# Altium schematic sheet big sheet.SchDoc: <Enter Sheet Title> (part 1 of 2)
size 1651 x 812 mm; Organization: NewAE Technology Inc.; Address1: 1083 Queen St., Suite 196; Address2: Halifax; Address3: NS; Address4: Canada B3H 0B2; SheetNumber: 1; SheetTotal: 18; SheetApproved: NO
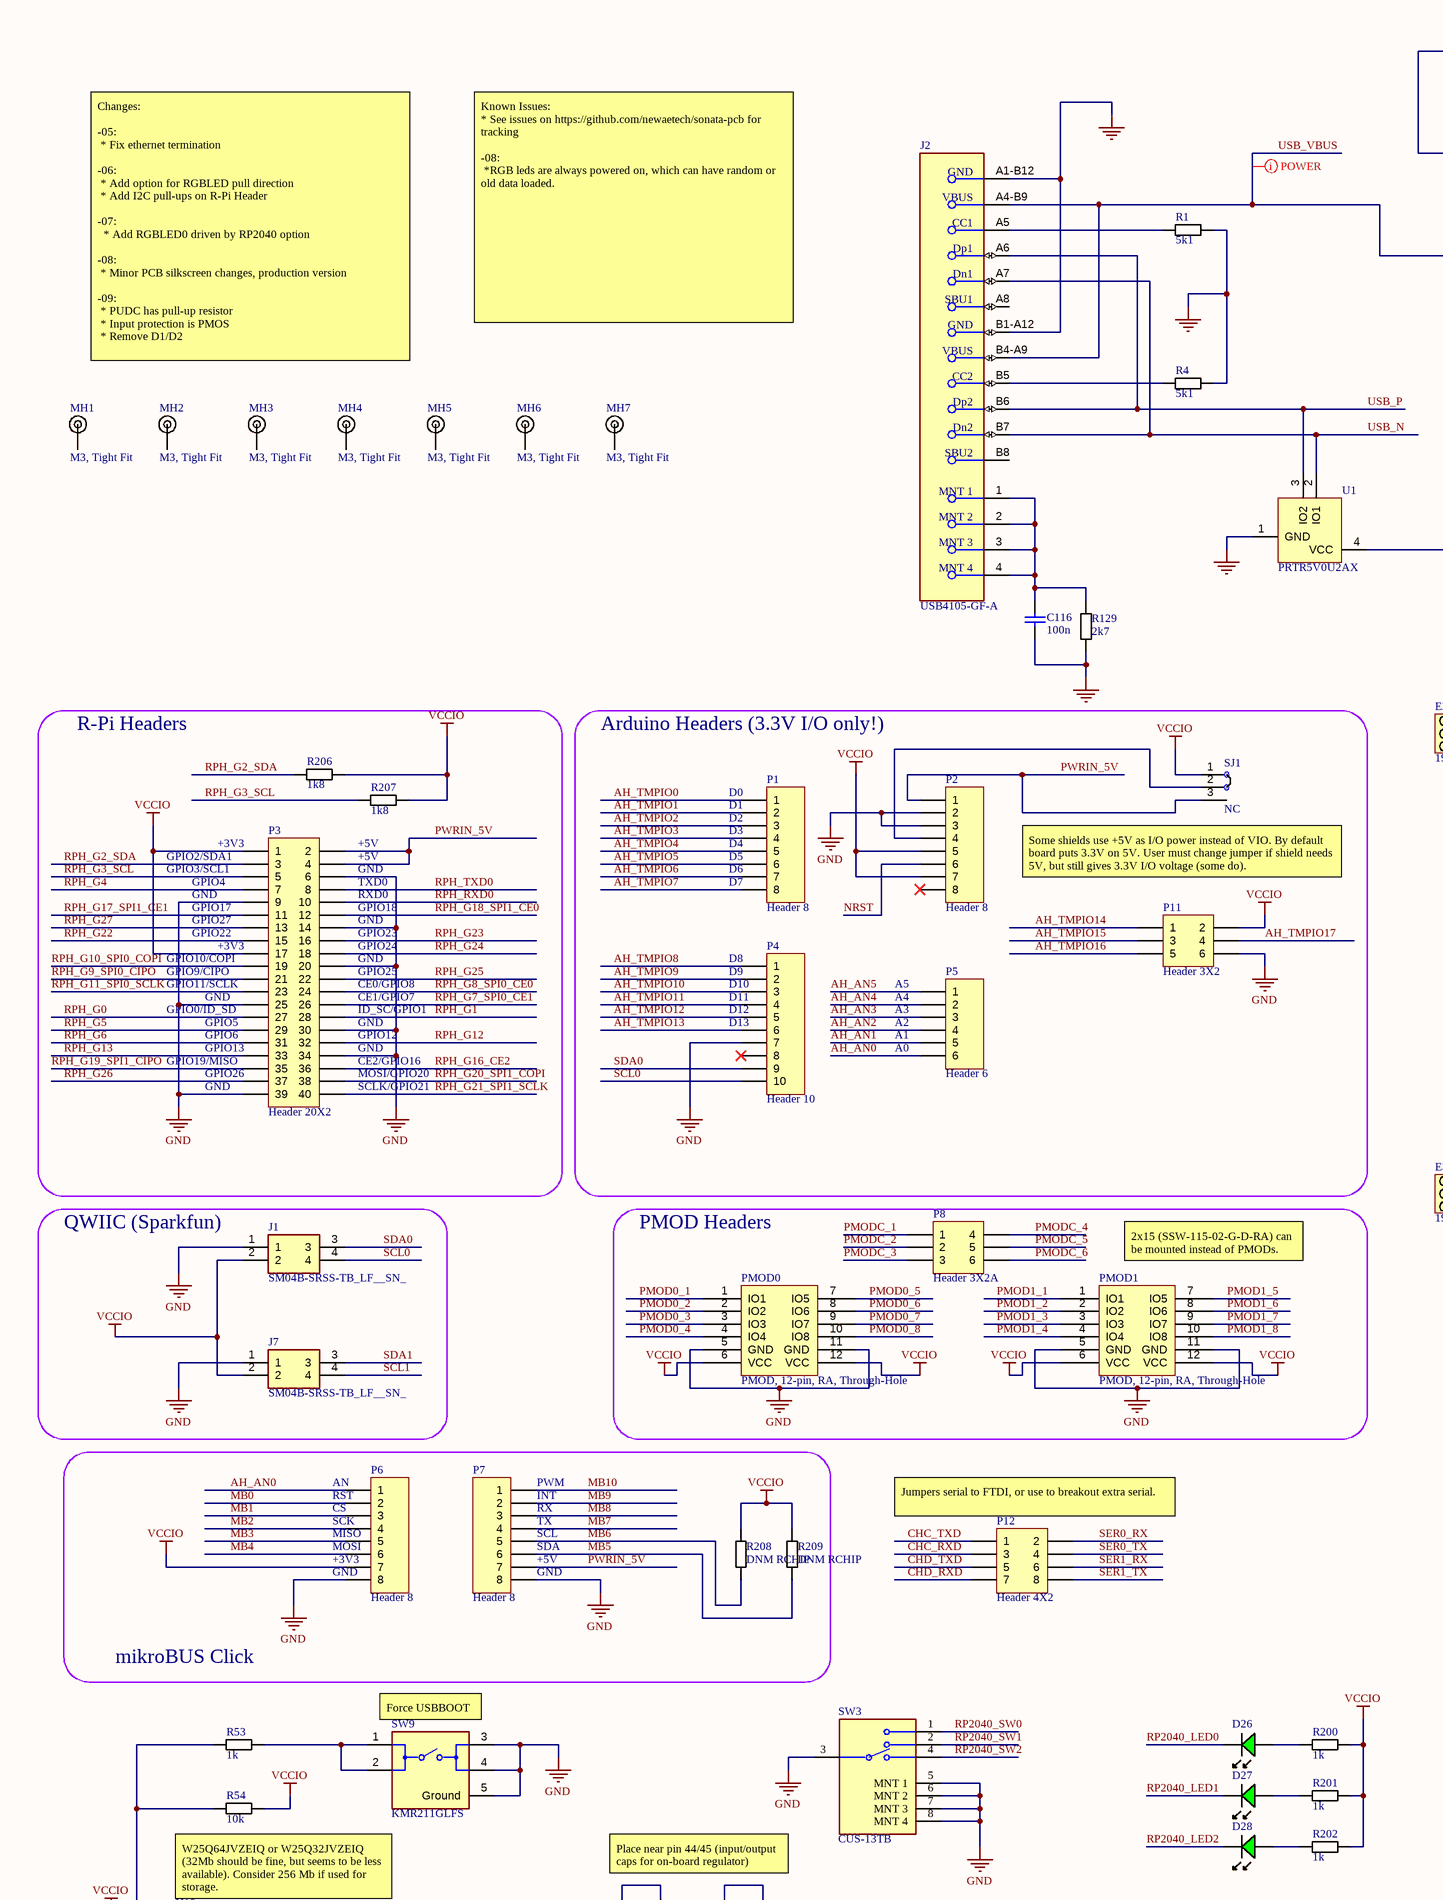
[diagram p0: big sheet.SchDoc, top column 1 of 4]
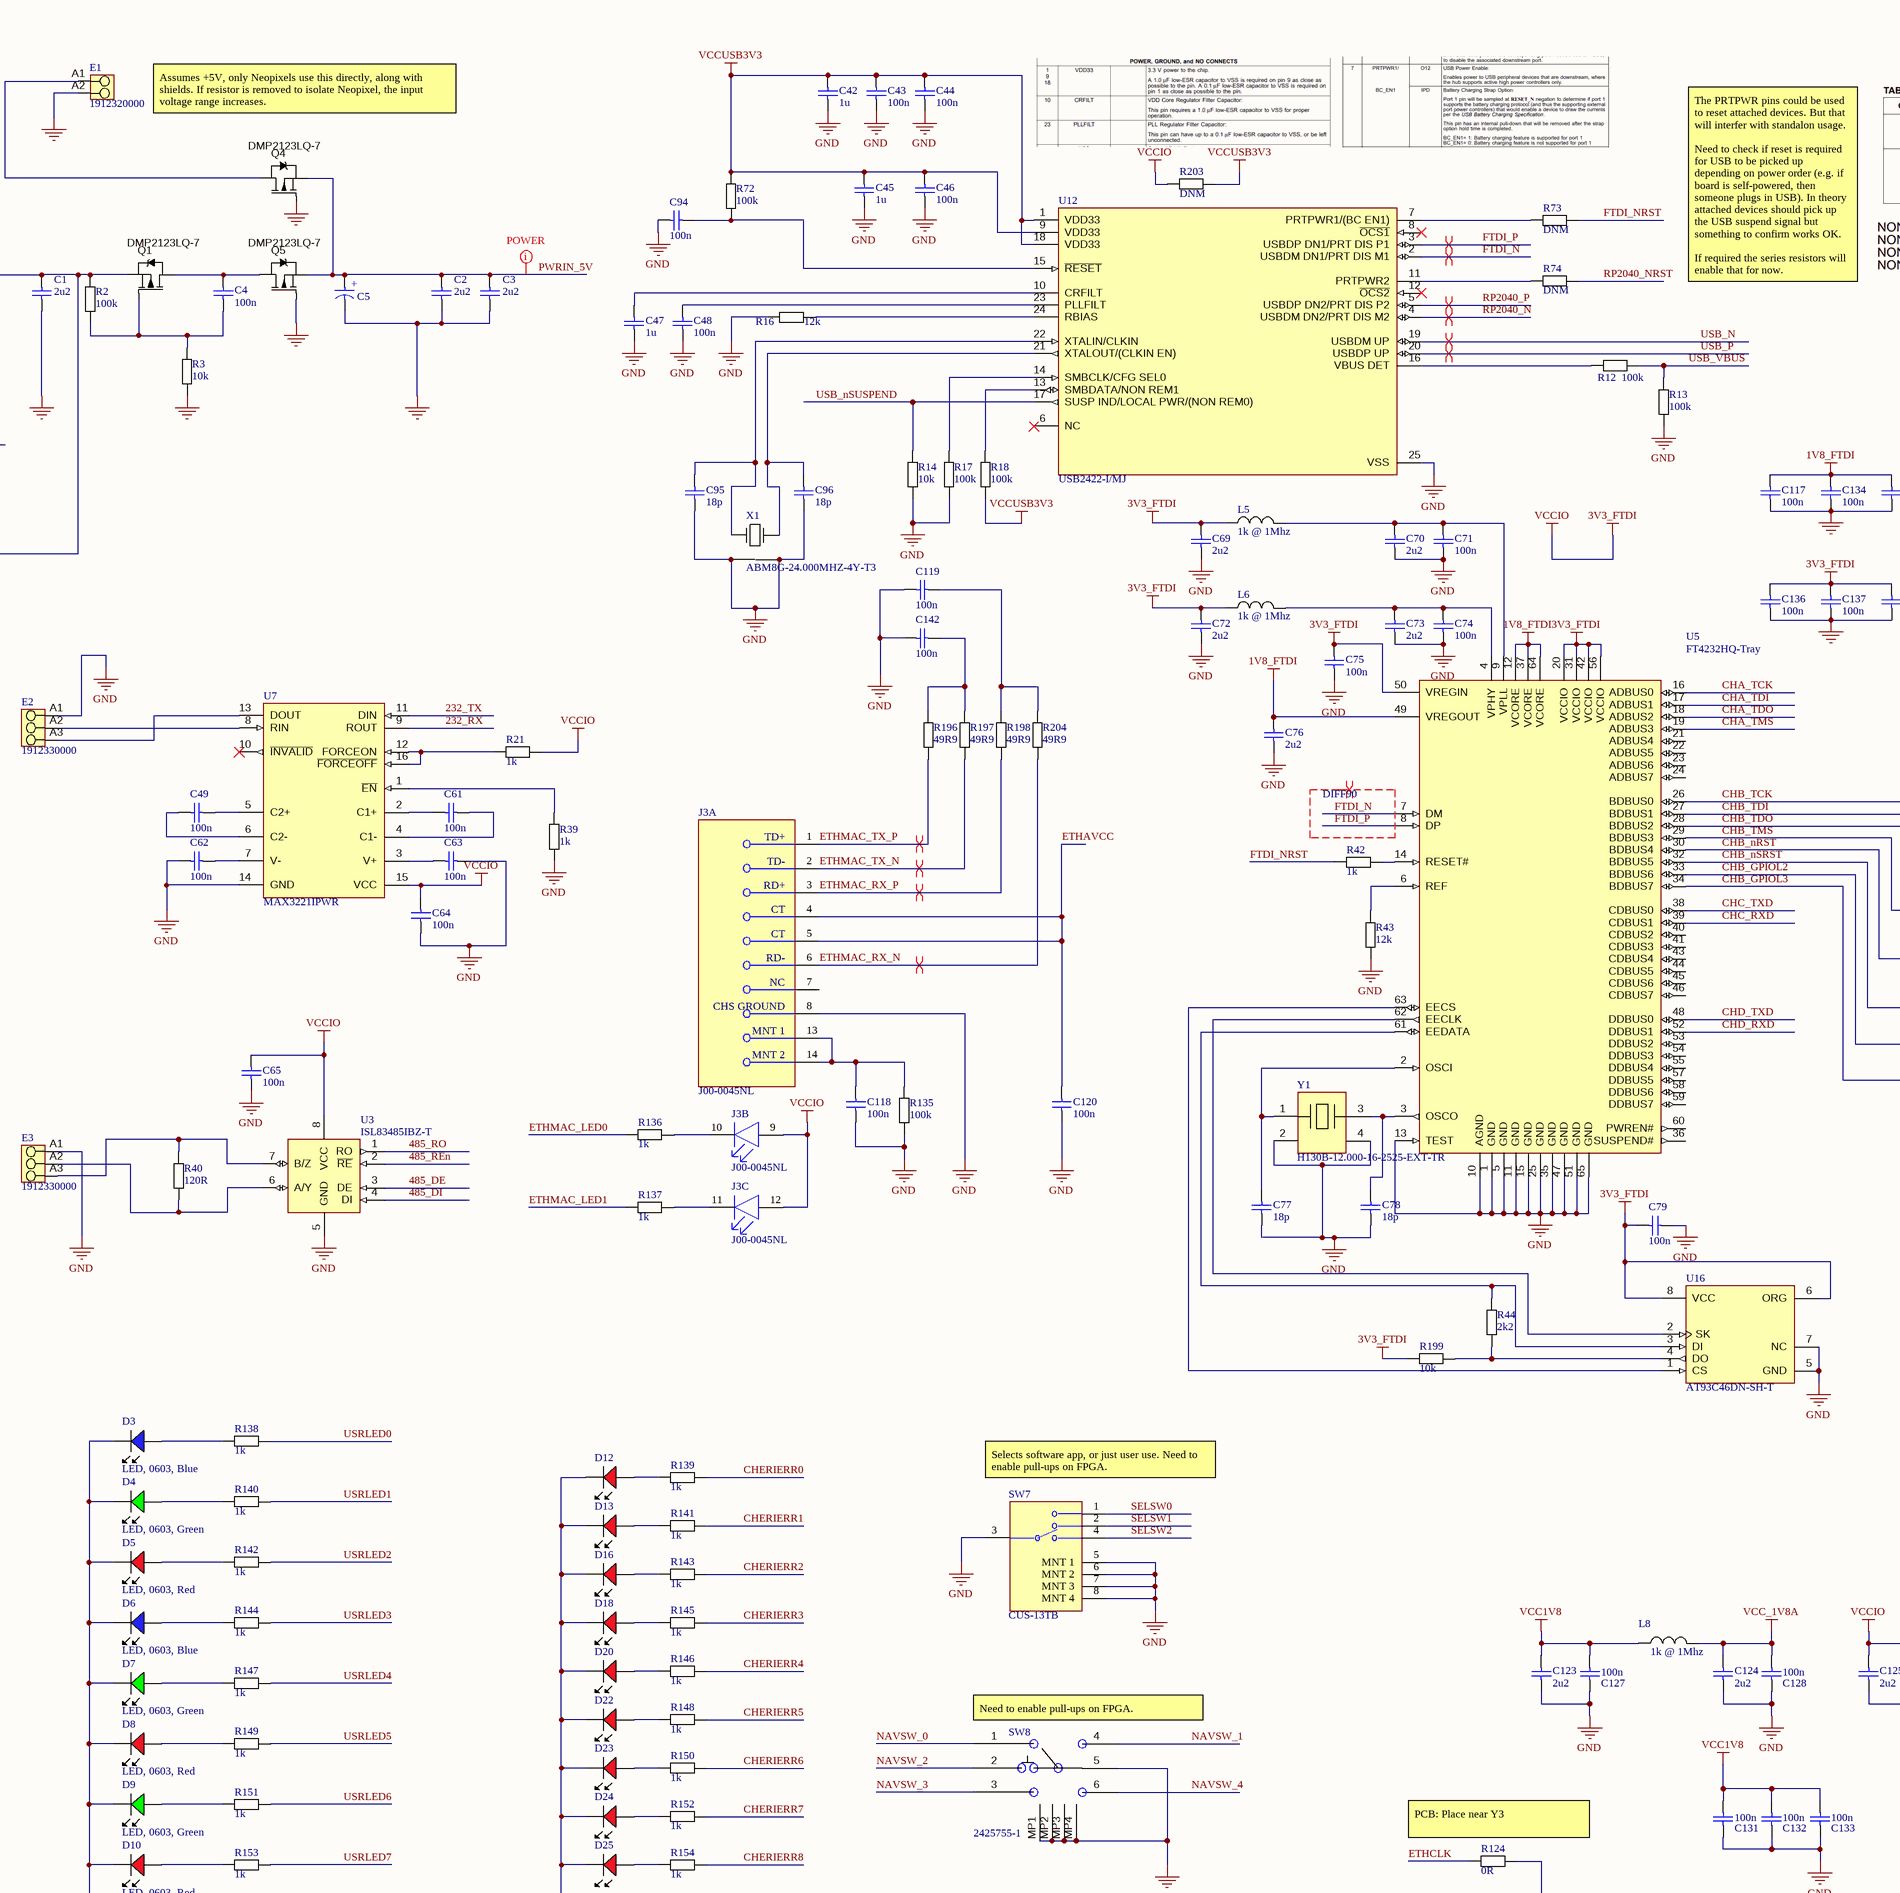
[diagram p1: big sheet.SchDoc, top column 2 of 4]
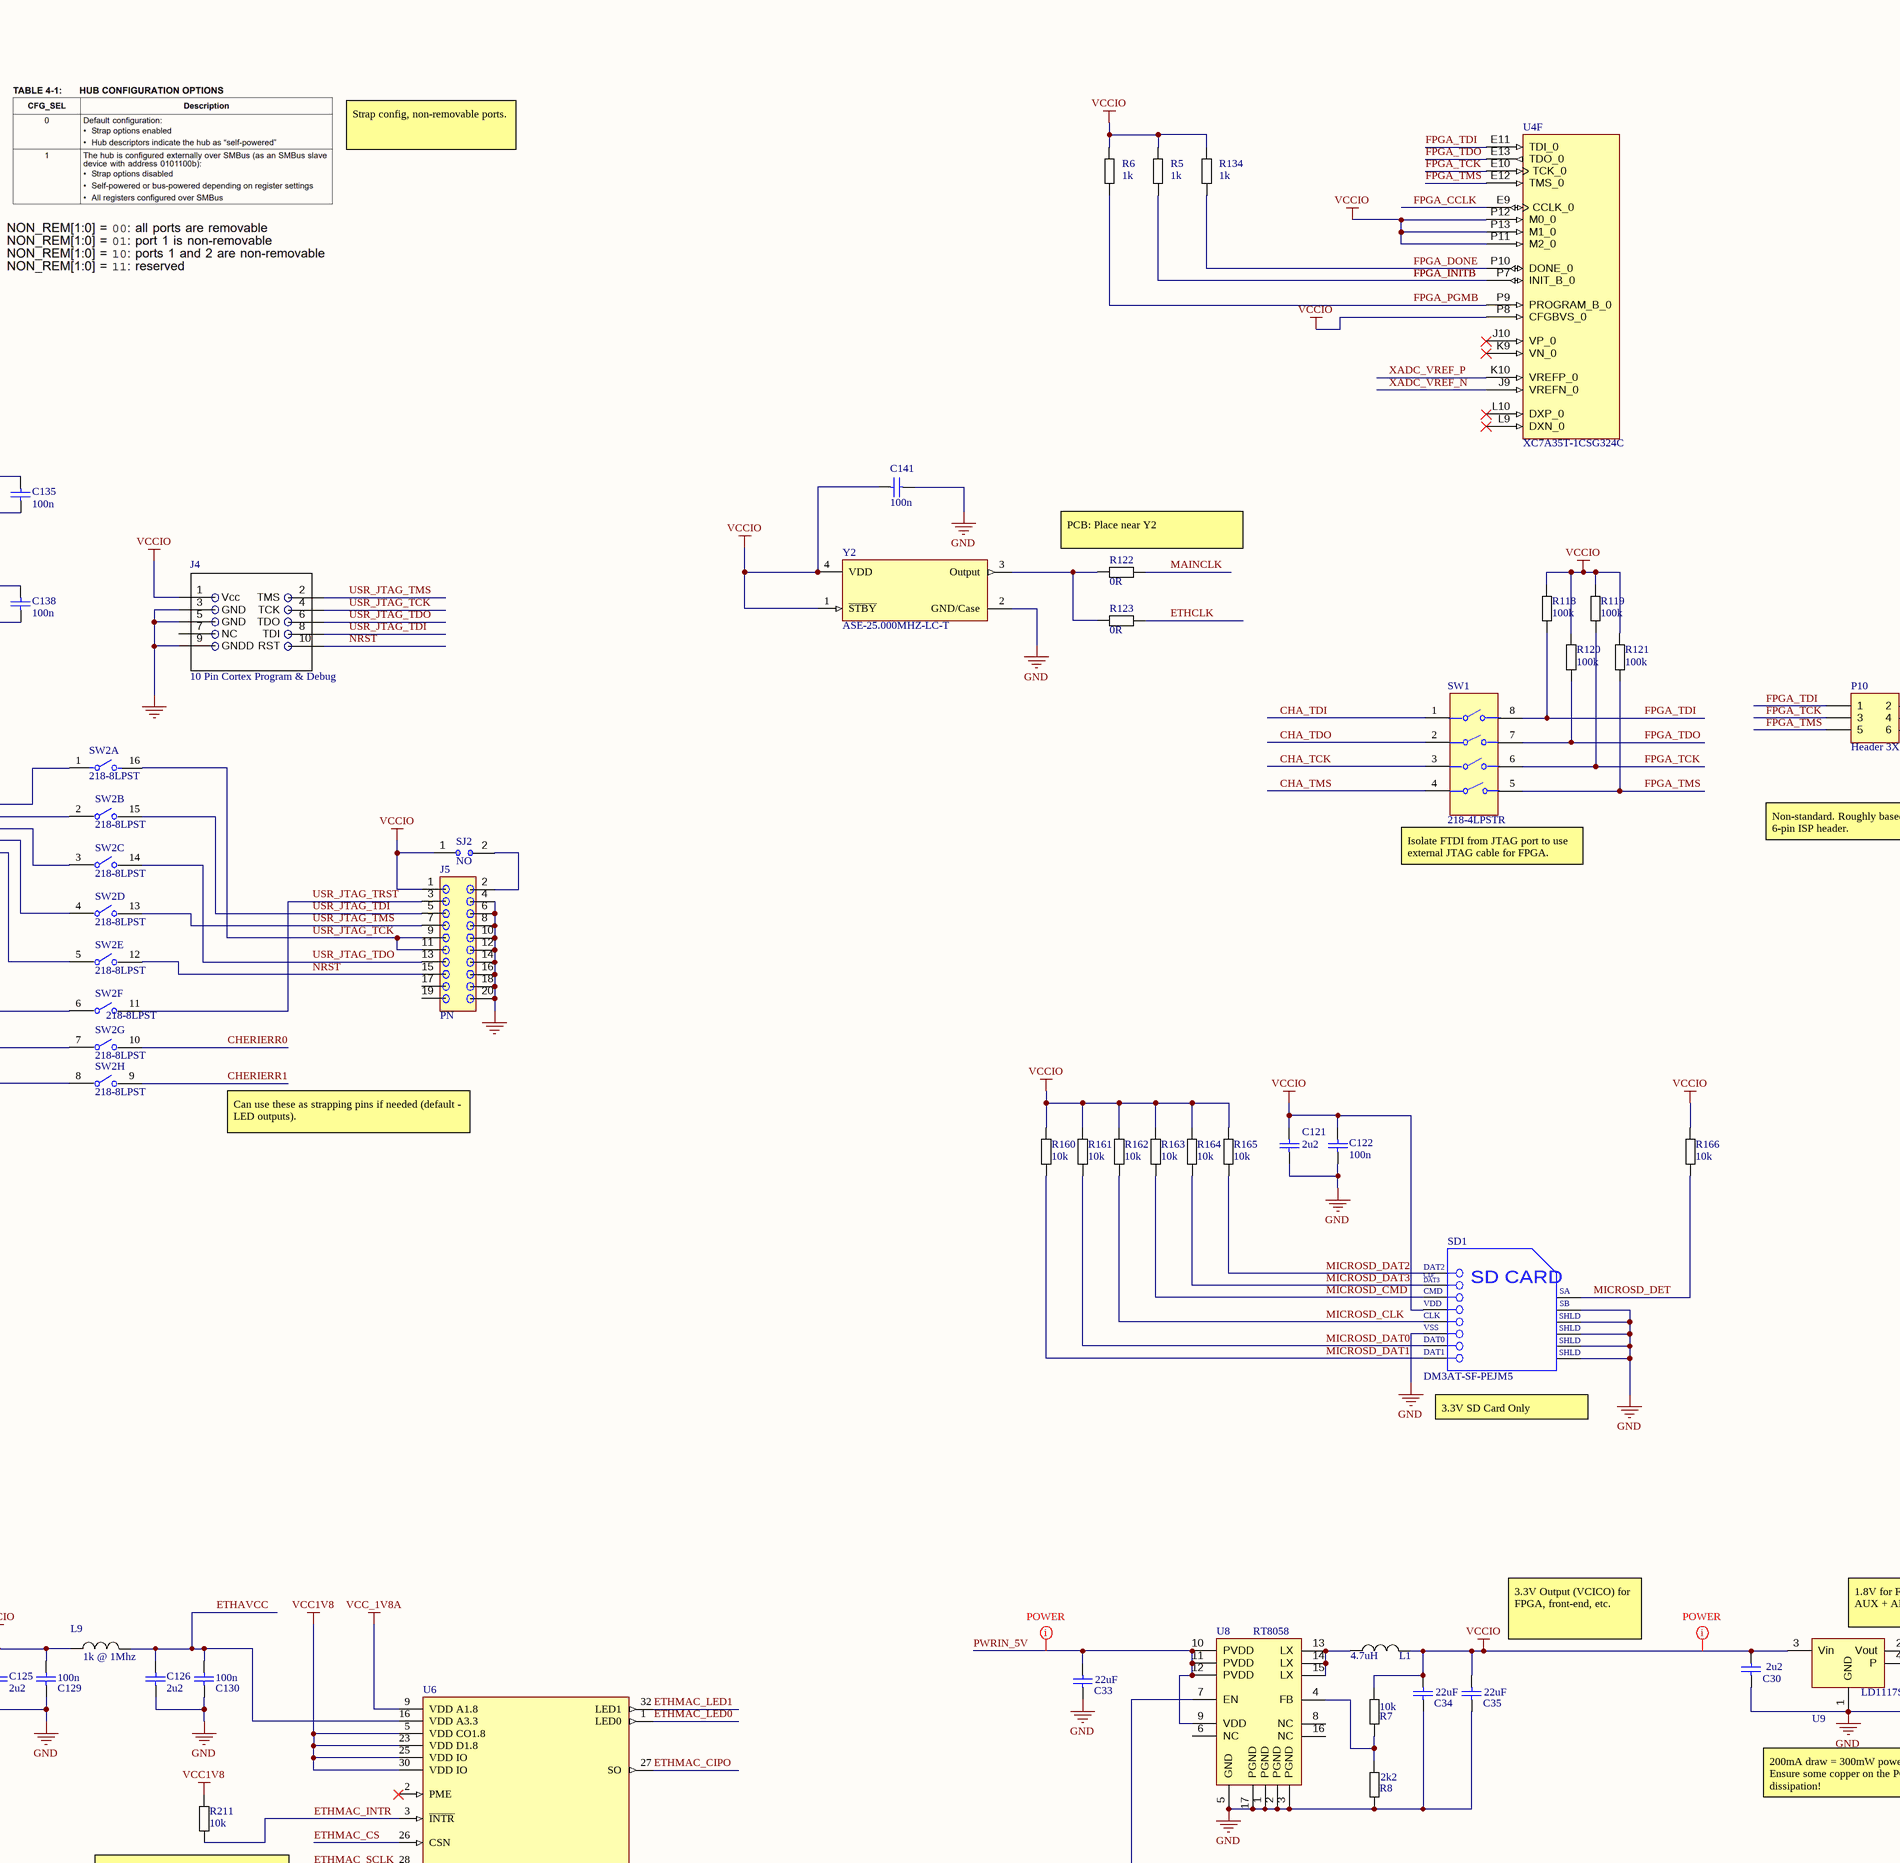
[diagram p2: big sheet.SchDoc, top column 3 of 4]
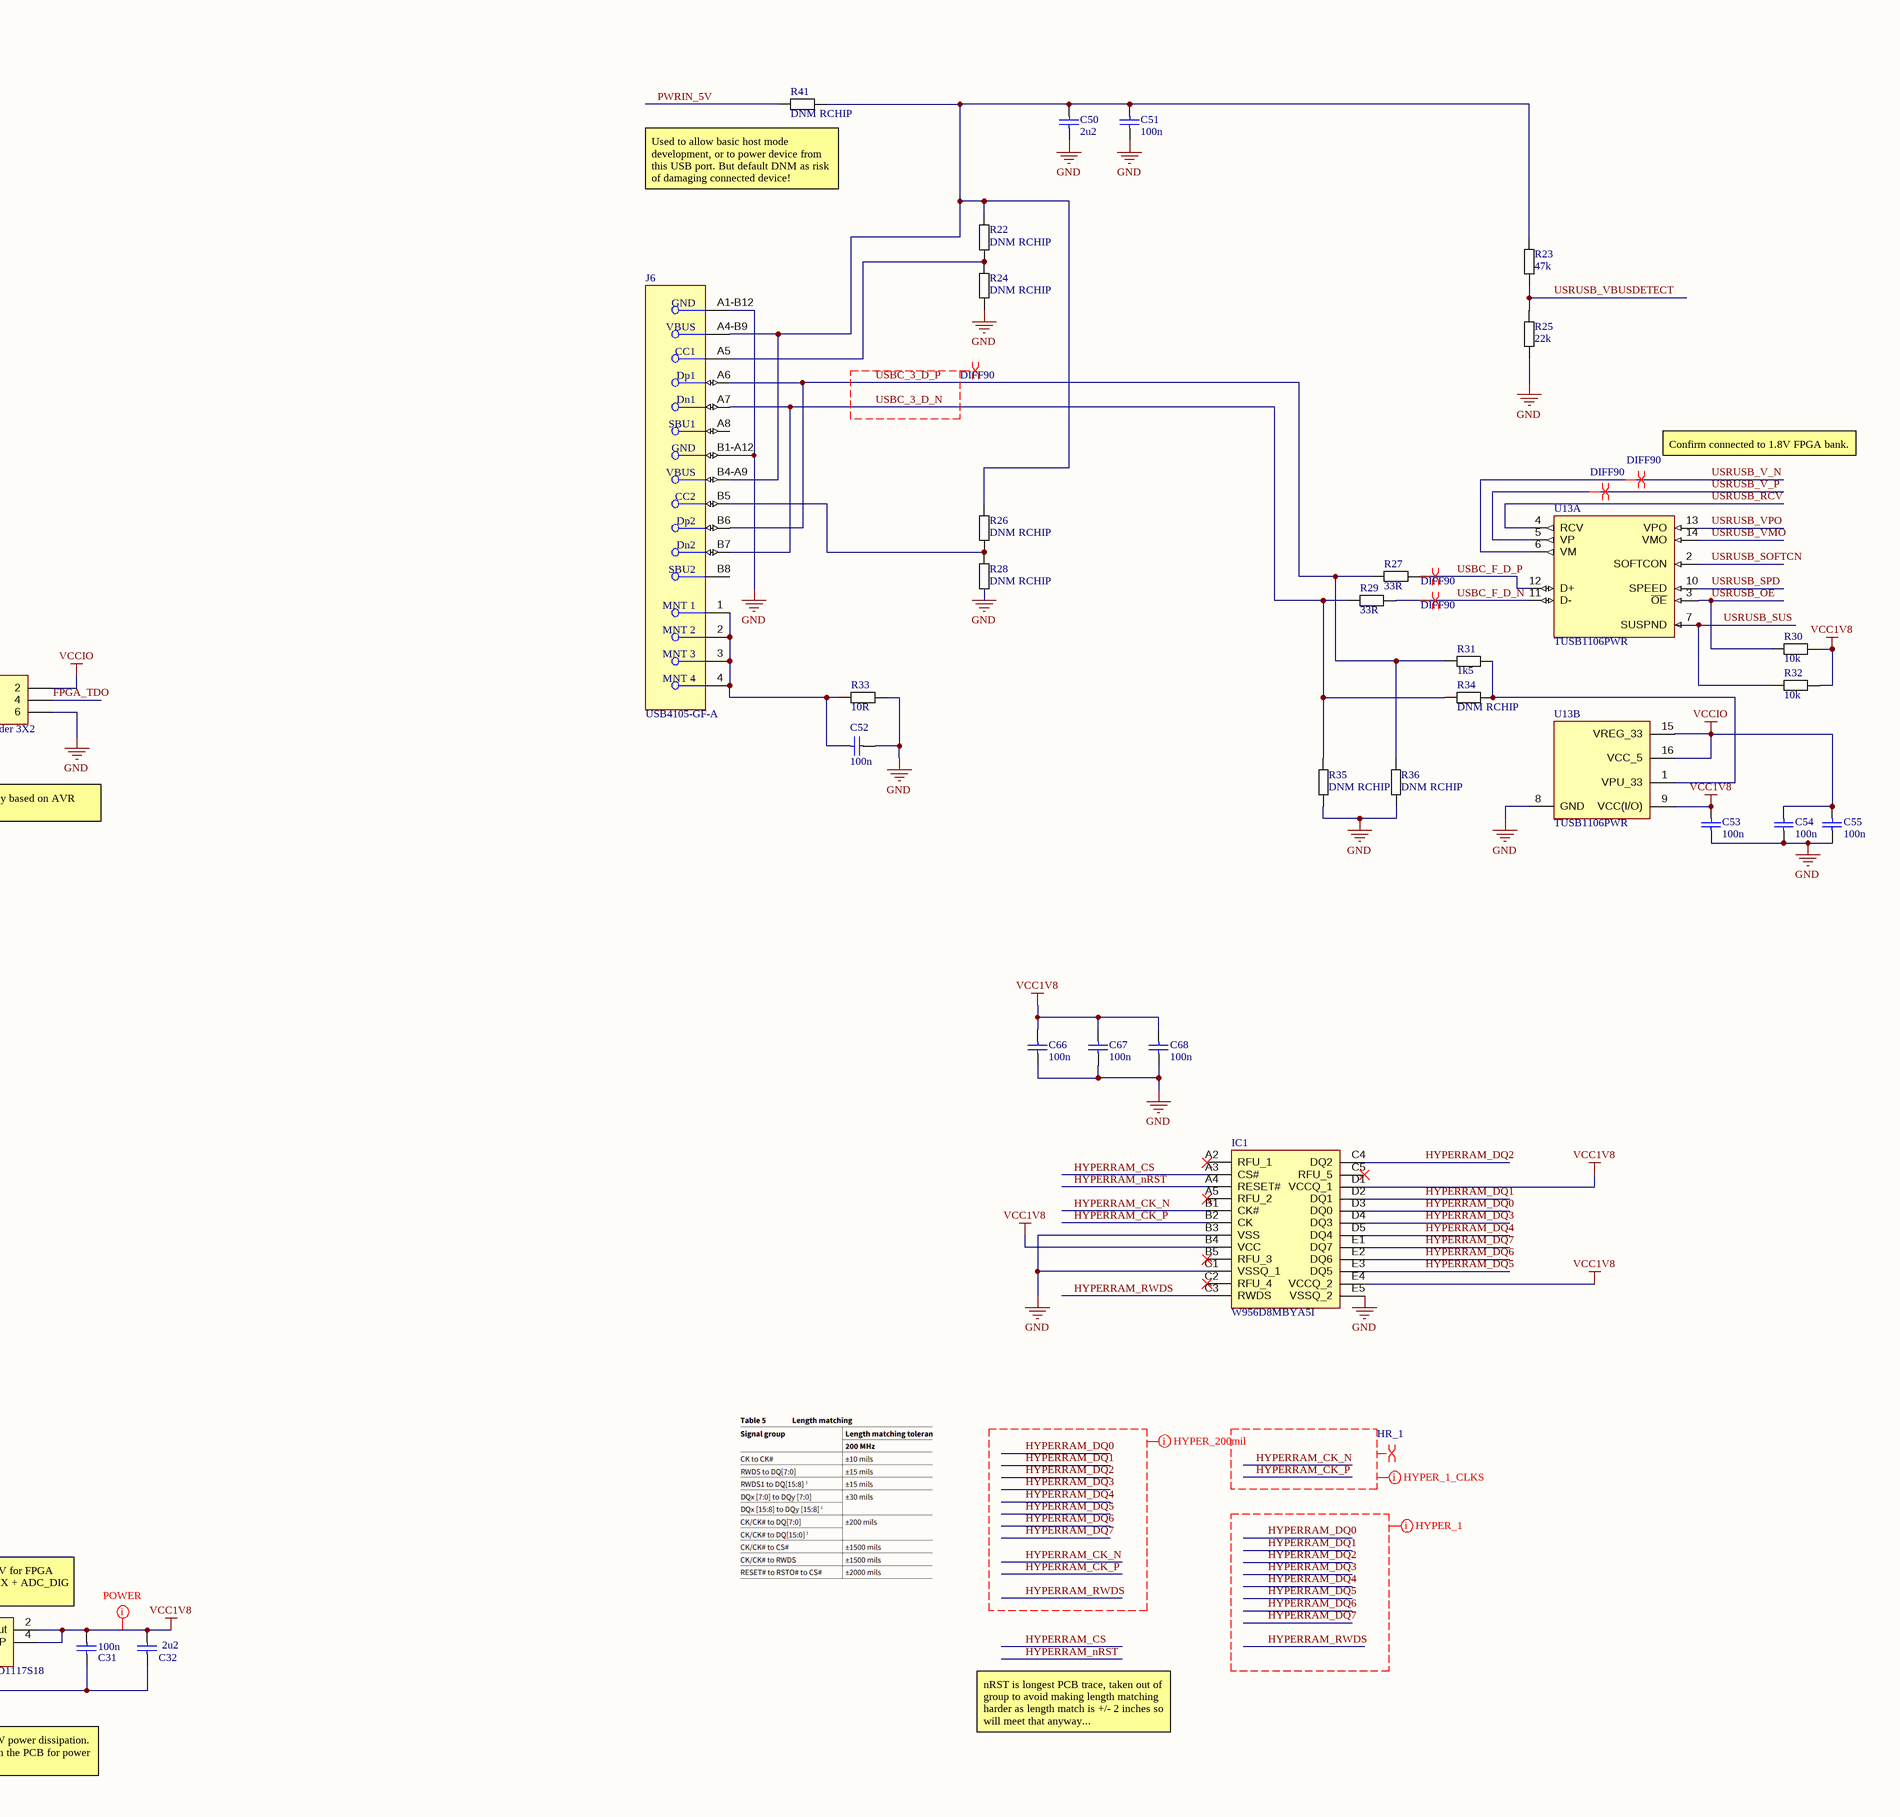
[diagram p3: big sheet.SchDoc, top column 4 of 4]
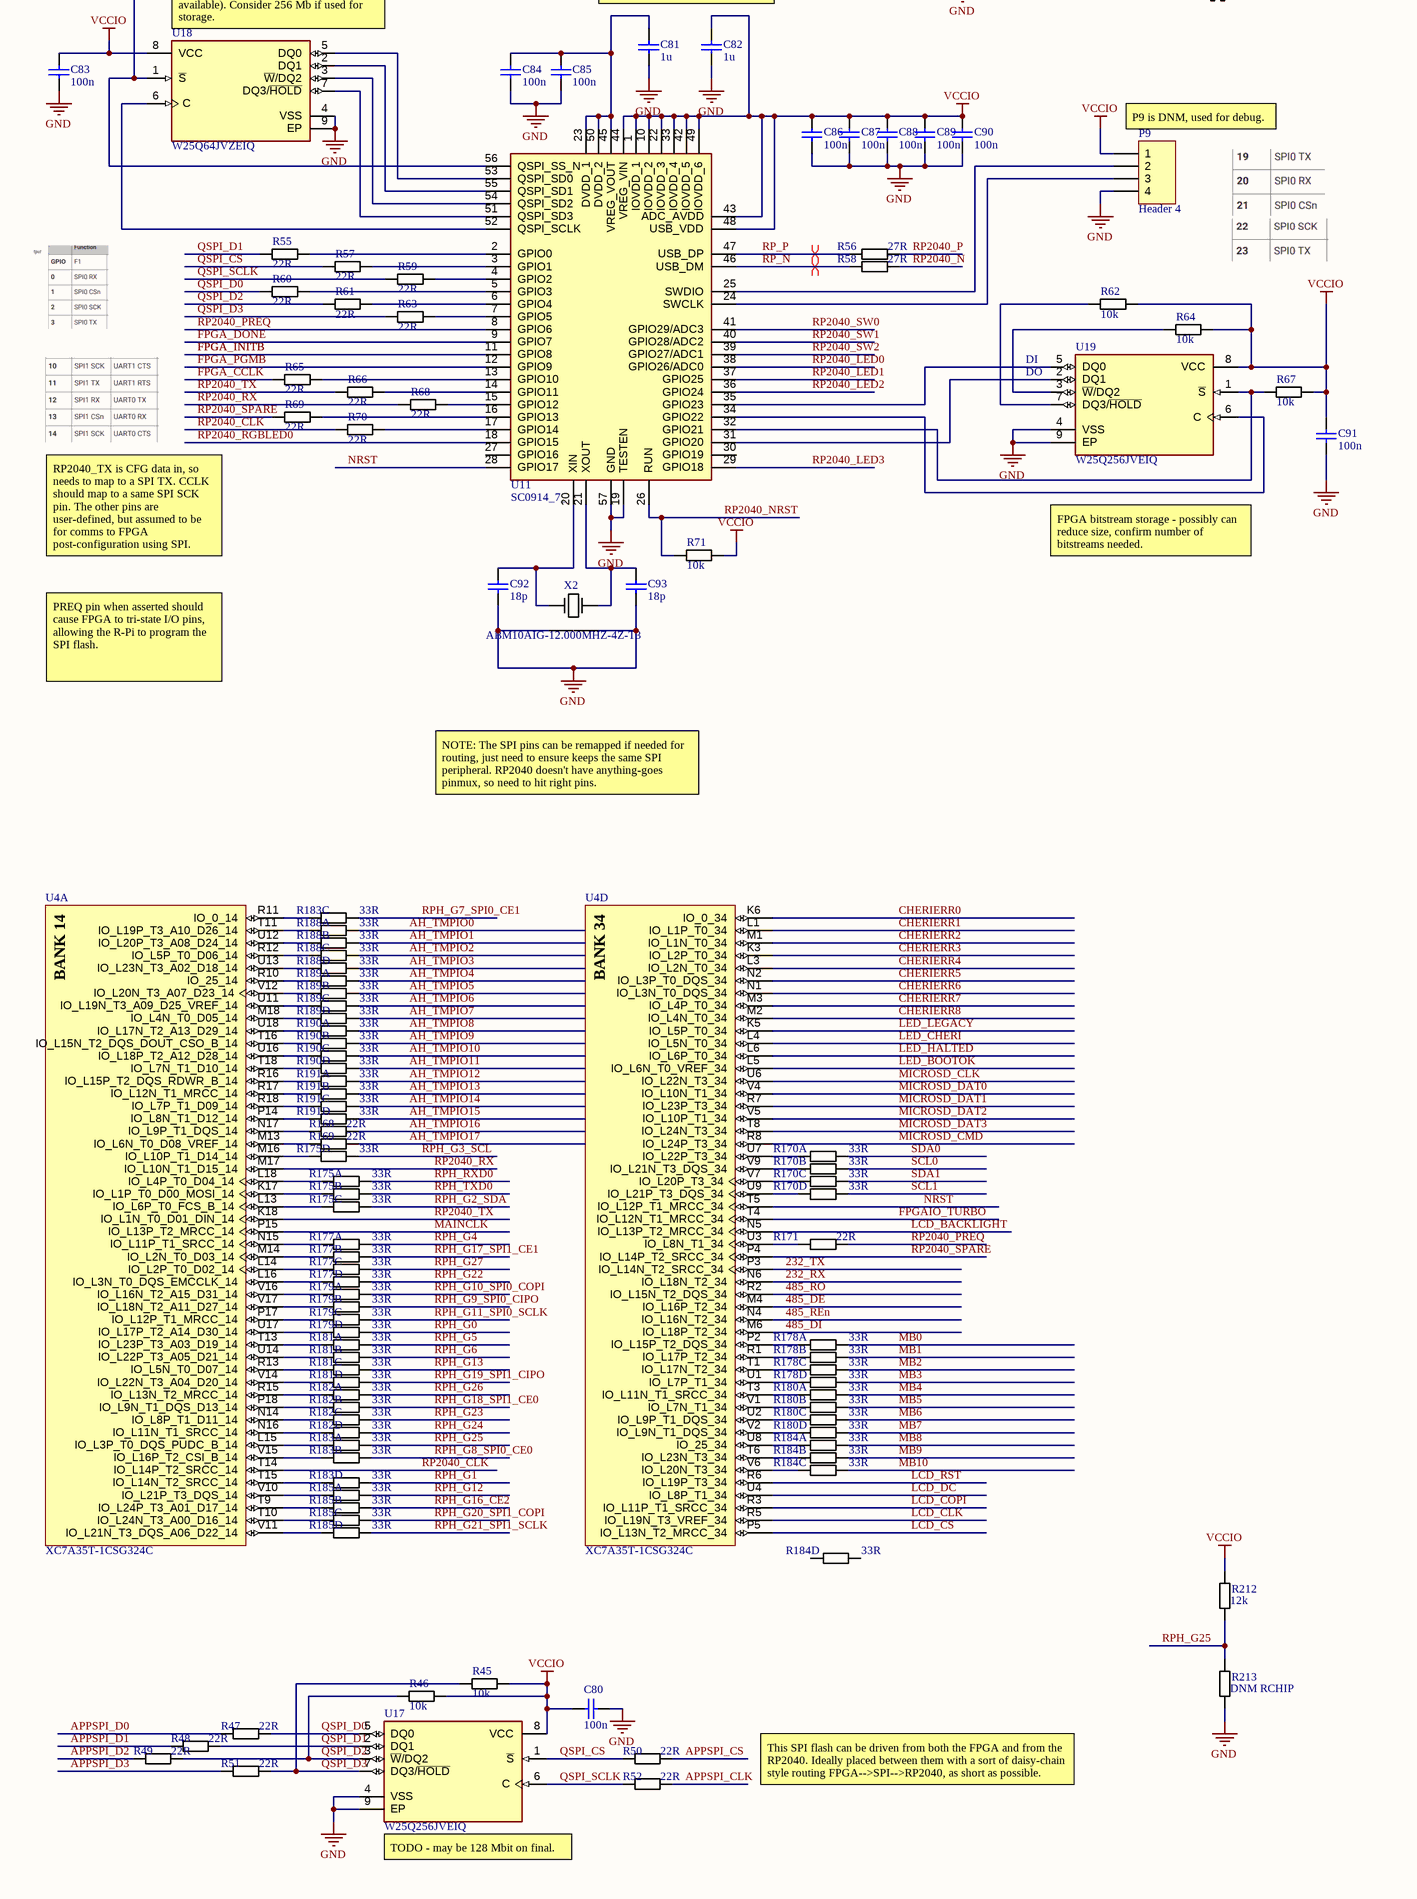
[diagram p4: big sheet.SchDoc, bottom column 1 of 4]